# EasyEDA Pro project MyWordEdit.eprj, board PCB1 (continued)
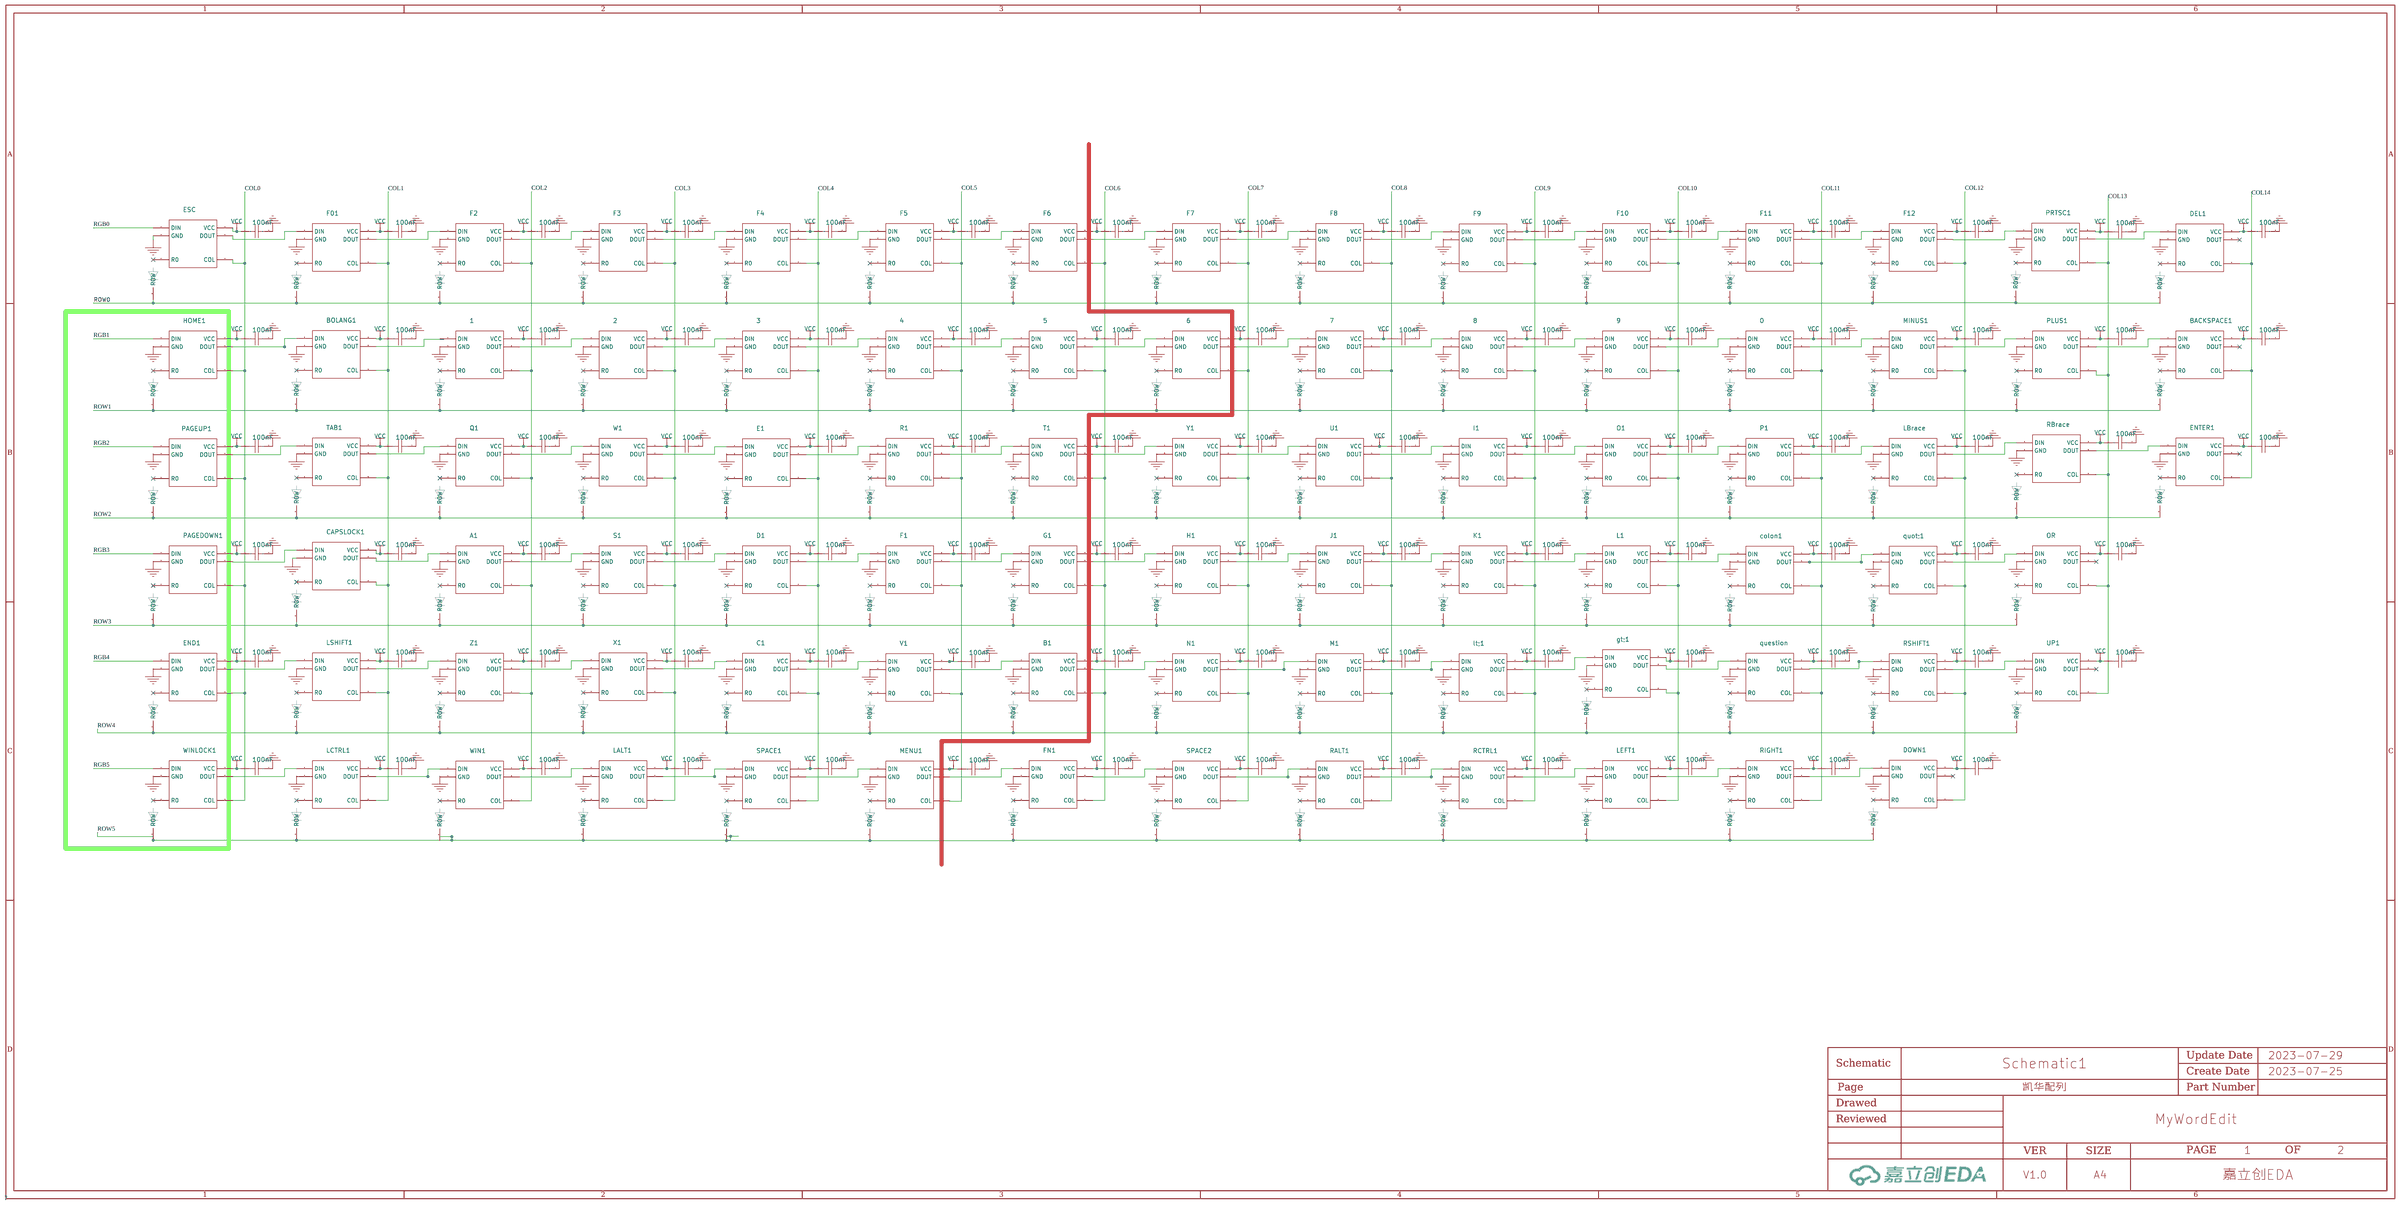
[diagram p0: 凯华配列]
## Routing (per net, layer and track width the routed paths; a pad name or vN(x,y) marks a point on that pad's centre or on a via; arc(x,y) is an arc through that point) (continued)
  Bottom Layer w0.254: v1(252.86,43.69) 252.86,45.17 253.03,45.34 252.9,45.47 ; 103.31,5.72 101.09,5.72 ; 103.31,5.72 107.19,5.72 108.08,4.83 POWER_BATTARY.2 ; 103.31,5.72 C3.2 ; 101.09,5.72 100.71,5.33 C4.2 ; 101.09,5.72 96.52,5.72 ; v1(172.09,110.49) 172.47,110.11 180.49,110.11 181.99,111.61 ; v1(192.66,92.58) 192.79,92.71 201.3,92.71 202.1,93.51 8.GND 202.63,94.74 v1(206.25,94.74) v1(206.25,96.39) ; v1(301.88,61.72) v1(304.29,59.31) ; v1(122.17,98.06) v1(122.17,94.11) 120.91,95.37 4.GND 117.03,95.12 116.28,94.36 109.73,94.36 109.47,94.61 108.46,94.61 v1(108.2,94.36) ; Z1.GND 81.28,41.4 v1(81.92,42.04) 77.39,46.56 57.2,46.56 v1(55.88,47.88) ; U1.GND 194.25,74.37 v1(197.87,74.37) 194.13,78.1 178.38,78.1 C_Y1.2 179.96,75.61 v1(179.96,74.17) ; v1(244.09,101.47) 243.18,102.39 C_00.2 ; v1(244.6,97.41) 244.6,98.97 243.8,99.78 ; v1(160.66,111.51) 157.04,111.51 F6.GND 156.66,110.87 155.77,109.98 148.08,109.98 v1(147.32,110.74) ; W1.GND 89.53,78.99 v1(90.3,79.76) 89.87,79.76 87.71,81.91 86.87,81.91 83.78,85 C_Q1.2 73.03,83.65 v1(73.03,82.8) ; 214.9,42.54 216.79,42.54 217.51,43.27 231.1,43.27 233.68,40.69 v1(233.68,40) 233.02,39.34 lt;1.GND ; 214.9,42.54 215.77,41.67 v1(215.77,40.39) ; 214.9,42.54 C_M1.2 ; v1(225.17,118.74) 223.57,120.35 C_F9.2 ; 143.26,114.17 v1(143.26,114.93) ; 143.26,114.17 141.86,112.77 137.74,112.77 137.74,112.52 136.98,111.76 129.16,111.76 v1(128.91,112.01) ; 143.26,114.17 v1(145.42,112.01) ; v1(105.92,120.14) 105.79,120.27 C_F3.2 ; v1(27.18,50.93) 27.18,44.14 25.08,42.04 v1(25.02,42.04) ; PAGEUP1.GND 21.54,94.36 24.64,94.36 26.92,96.65 26.92,101.47 ; 45.03,63.5 49.65,63.5 v1(50.67,64.52) 50.67,65.67 C_CAPSLOCK.2 48.83,67.5 47.88,66.55 46.1,66.55 45.34,67.31 36.45,67.31 v1(33.66,64.52) ; 36.32,8.51 35.01,7.2 C10.2 ; 36.32,8.51 32.35,8.51 ; 36.32,8.51 v1(38.1,8.51) 39.37,8.51 ; 26.92,101.47 v1(27.69,102.23) ; 26.92,101.47 25.03,99.58 C_PAGEUP.2 ; 295.57,64.11 295.53,64.07 295.53,63.37 294.64,62.48 283.34,62.48 v1(282.83,62.99) ; 295.57,64.11 298.59,67.13 C_OR.2 298.59,72.12 v1(297.31,73.41) ; 295.57,64.11 299.49,64.11 v1(299.85,63.75) ; v1(51.56,84.45) 54.1,86.99 61.85,86.99 64.26,84.58 68.2,84.58 v1(71.5,81.28) 70.99,80.77 68.14,80.77 Q1.GND ; v1(197.87,76.58) 197.87,78.98 C_U1.2 213.01,79.68 216.23,76.45 v1(216.15,76.45) 215.75,76.05 I1.GND ; ENTER1.GND 318.11,75.54 319.02,76.45 319.02,79.76 314.96,83.82 v1(295.78,83.82) ; v1(155.58,71.12) 155.58,70.97 157.61,68.94 SWD.4 ; 221.12,95.76 221.12,95.52 219.96,94.36 212.34,94.36 v1(212.22,94.23) ; 221.12,95.76 v1(225.3,95.76) 225.3,97.75 v1(225.43,97.88) ; 221.12,95.76 9.GND ; v1(284.73,100.96) 284.73,101.22 v1(282.83,103.12) 280.65,100.94 PLUS1.GND 277.91,100.5 276.73,99.31 v1(268.73,99.31) ; 51.94,48.63 51.94,45.08 50.92,44.06 LSHIFT1.GND ; 51.94,48.63 C_LSHIFT.2 ; 51.94,48.63 52.69,47.88 v1(54.23,47.88) ; v1(95.38,24.89) 119.89,24.89 C_SPACE1.2 123.32,21.46 v1(123.32,20.57) 121.66,18.92 SPACE1.GND ; 252.9,45.47 C_GT;1.2 ; 252.9,45.47 256.92,45.47 257.68,46.23 267.84,46.23 268.35,45.72 270,45.72 272.16,43.56 v1(272.16,42.67) 272.14,42.65 question.GND ; C_ENTER1.2 301.4,78.2 299.47,80.14 v1(296.04,80.14) 296.04,77.72 v1(297.31,76.45) ; 86.23,6.35 87.88,6.35 88.52,5.72 92.46,5.72 ; 86.23,6.35 85.22,5.34 C7.2 ; 86.23,6.35 77.85,6.35 76.45,7.75 71.62,7.75 ; v1(143.26,116.97) 141.47,116.97 C_F5.2 ; v1(31.88,101.6) 32.51,100.96 40.33,100.96 41.22,101.85 41.22,102.1 42.27,102.1 43.42,103.25 v1(46.36,103.25) 46.36,100.96 v1(46.86,100.46) ; 138.81,23.24 128.65,23.24 v1(125.98,20.57) ; 138.81,23.24 145.09,23.24 C_MENU1.2 150.05,21.15 152.78,18.42 152.78,17.4 v1(151.64,16.26) 151.51,16.12 MENU1.GND ; 138.81,23.24 134.24,27.81 134.24,30.73 135.13,31.62 135.13,32.26 137.16,34.29 v1(139.7,34.29) ; 113.67,127.38 113.92,127.38 114.43,126.87 114.43,125.44 RPROG.1 ; 113.67,127.38 114.54,128.25 C2.1 114.54,129.81 113.28,131.06 104.8,131.06 103.02,129.29 102.17,129.29 ; 113.67,127.38 110.09,127.38 C19.1 ; v1(101.73,42.16) 101.78,42.21 C_X1.2 103.81,42.42 116.08,42.42 117.09,41.4 117.86,41.4 v1(120.02,39.24) 118.87,38.1 116.91,38.1 ; v1(188.6,111.51) 186.69,113.41 v1(186.69,114.05) 184.25,111.61 181.99,111.61 ; v1(51.44,120.65) 50.29,121.79 43.63,121.79 ESC.GND 42.87,120.46 42.29,119.89 38.99,119.89 38.74,120.14 34.29,120.14 v1(33.53,120.9) ; C_H1.2 185.5,58.95 v1(186.54,57.91) 182.83,54.2 H1.GND ; RIGHT1.GND 305.79,26.64 v1(306.83,27.69) 305.05,29.46 303.78,29.46 302.77,30.48 288.39,30.48 C_LEFT1.2 288.09,29.59 v1(289.43,29.59) ; 222.77,62.26 v1(224.07,60.96) 220.62,57.51 219.62,57.51 ; 222.77,62.26 221.21,60.71 208.28,60.71 v1(205.36,57.78) 205.36,59.11 C_J1.2 ; 222.77,62.26 C_K1.2 ; 322.96,47.37 320.99,47.37 320.93,47.31 ; 322.96,47.37 v1(326.01,47.37) ; 322.96,47.37 323.99,48.4 C_UP1.2 323.99,55.36 321.69,57.66 v1(305.94,57.66) ; WINLOCK1.GND 16.71,37.59 19.3,37.59 20.2,38.49 C_WINLOCK.2 20.71,42.04 v1(23.24,42.04) ; C_PLUS1.2 282.16,105.69 v1(282.96,104.9) ; 19.75,75.18 21.97,75.18 v1(24.64,77.85) 24.64,78.63 C_PAGEDOWN.2 ; 32.35,8.51 C11.2 ; 32.35,8.51 27.78,8.51 C12.2 ; v1(149.61,76.58) 152.53,76.58 v1(154.43,74.68) ; v1(149.61,76.58) 149.61,76.59 144.92,81.28 142.88,81.28 142.55,81.61 142.55,93.17 v1(142.11,93.6) 143.89,93.6 v1(144.02,93.47) ; v1(149.61,76.58) 150.88,75.31 v1(150.88,70.87) ; v1(244.86,62.1) 246.76,64.01 259.17,64.01 C_COLON1.2 260.79,64.14 v1(262.06,62.86) 260,60.81 colon1.GND ; 138.55,36.44 138.94,36.44 v1(139.7,35.69) ; 138.55,36.44 138.55,37.85 v1(138.05,38.35) 136.91,39.5 136.65,39.5 135.31,40.84 122.53,40.84 C_C1.2 120.7,41.2 v1(120.65,41.15) ; 138.55,36.44 V1.GND ; v1(263.52,102.71) 263.52,103 C_MINUS1.2 ; v1(242.7,120.78) 241.5,121.98 C_F10.2 ; 243.8,99.78 241.53,97.51 0.GND 239.94,96.56 239.27,95.88 v1(230.63,95.88) ; 243.8,99.78 v1(243.84,99.82) ; v1(26.42,128.52) 26.42,128.4 27.43,127.38 30.04,127.38 32.13,125.29 32.13,122.05 v1(30.99,120.9) 29.34,120.9 C_ESC1.2 ; C_09.2 224.31,100.68 v1(225.43,99.57) ; C_B1.2 158.37,39.38 v1(158.37,40.51) ; C_F01.2 65.02,124.24 66.07,123.19 v1(67.95,123.19) 71.98,123.19 72.47,123.68 72.47,124.46 ; v1(229.36,114.55) 233.81,114.55 234.19,114.93 237.49,114.93 238.5,115.95 238.5,116.35 F10.GND 241.02,116.56 243.08,118.62 ; 323.09,27.7 323.36,27.43 v1(325.63,27.43) ; 323.09,27.7 v1(323.09,26.67) ; 323.09,27.7 DOWN1.GND 322.49,27.34 321.82,26.67 311.53,26.67 v1(309.37,28.83) 309.37,28.85 C_RIGHT1.2 ; v1(264.03,121.03) v1(264.03,118.24) 257.37,118.24 F11.GND 257.34,117.51 256.54,116.71 253.75,116.71 253.37,116.33 v1(248.41,116.33) ; U6.63 164.96,53.72 165.1,53.58 v1(165.1,53.34) ; O1.GND 233.74,79.25 v1(234.82,79.25) 233.68,80.39 232.41,80.39 231.14,81.66 217.59,81.66 216.79,80.86 C_I1.2 217.81,79.22 v1(217.81,78.23) ; C_01.2 64.52,105.28 v1(65.15,104.65) ; 249.72,41 252.32,41 v1(252.86,41.53) 249.94,44.45 233.95,44.45 C_LT;1.2 233.68,44.18 v1(233.68,42.54) ; v1(88.14,117.09) 86.74,118.49 v1(86.61,118.49) 85.85,117.72 F2.GND 80.84,117.15 80.28,116.59 72.52,116.59 v1(71.63,117.47) ; v1(87.76,119.63) 85.04,122.35 82.62,122.35 ; 96.52,5.72 92.46,5.72 ; 96.52,5.72 96.27,5.46 96.27,4.12 C5.2 ; 92.46,5.72 91.57,4.83 C6.2 ; v1(286,119.89) 294.27,119.89 295.31,120.93 295.31,121.51 295.42,121.41 v1(298.07,121.41) ; quot;1.GND 277.31,63.25 v1(280.04,63.25) 280.04,66.81 279.67,67.18 278.52,66.04 266.95,66.04 v1(263.78,62.86) ; R1.GND 127.25,75.56 v1(128.65,76.96) 127.74,77.88 127.23,77.88 124.2,80.9 110.45,80.9 110.11,81.24 ; C8.2 166.79,25.7 S2.2 170.28,26.95 169.16,28.07 C17.2 169.16,30.99 167.77,32.38 165.23,32.38 164.6,33.01 C18.2 163.79,33.02 v1(158.88,33.02) ; C_PRTSC1.2 300.61,124.53 v1(300.61,122.17) 301.12,121.67 313.18,121.67 ; 147.13,54.48 146.76,54.11 146.76,50.88 146.25,50.37 146.25,49.73 145.42,48.89 145.42,45.85 147.45,43.81 149.48,43.81 v1(153.8,39.5) ; 147.13,54.48 G1.GND ; 147.13,54.48 148.53,54.48 150.29,56.25 150.29,58.41 150.63,58.75 C_G1.2 150.5,59.57 v1(150.5,61.34) ; 109.03,57.91 111.38,57.91 v1(113.28,59.82) 113.28,61.66 C_D1.2 112.66,61.48 112.46,61.28 108.39,61.28 107.7,61.98 v1(97.03,61.98) ; C_05.2 140.28,98.22 v1(141.35,97.15) ; v1(53.21,64.52) 73.66,64.52 74.69,65.54 C_A1.2 75.31,65.16 v1(75.31,63.12) 73.4,61.21 A1.GND ; v1(27.18,53.97) v1(27.18,58.17) 27.31,58.17 v1(32.13,62.99) ; v1(53.09,29.72) 57.97,29.72 60.26,27.43 63.75,27.43 64.44,28.12 C_WIN1.2 65.91,28.58 v1(68.33,26.16) 66.04,23.88 60.65,23.88 60.65,23.87 ; v1(207.65,112.9) 207.65,113.79 v1(205.99,115.44) 203.81,113.26 F8.GND 200.66,112.92 200.66,112.65 199.77,111.76 197.08,111.76 196.83,111.51 v1(191.14,111.51) ; v1(162.94,53.34) 162.18,52.58 160.27,52.58 159.13,51.43 ; 110.11,81.24 v1(110.11,79.37) ; 110.11,81.24 C_E1.2 ; U6.47 158.42,52.14 159.13,51.43 ; v1(38.74,10.54) 46.07,10.54 51.53,5.08 C16.2 56.1,6.73 60.55,6.73 ; C_ESC1.2 C_HOME.2 14.99,121.79 8.01,114.81 5.23,114.81 SW_PWR_EN.1 4.32,115.86 ; C_ESC1.2 28.45,115.95 25.78,113.28 23.19,113.28 HOME1.GND ; BTK-05.22 BTK-05.23 154.84,123.47 153.42,122.05 153.42,117.42 BTK-05.13 148.46,117.35 146.43,119.38 135.38,119.38 133.73,117.73 131.06,117.73 129.67,119.13 v1(129.54,119.13) ; v1(153.8,39.5) 153.75,39.45 140.98,39.45 C_V1.2 139.19,40.96 v1(139.19,39.5) ; v1(153.8,39.5) 156.06,37.24 157.46,37.24 158.37,36.33 v1(158.37,35.05) 157.86,34.54 155,34.54 B1.GND ; v1(266.95,118.11) 267.21,118.36 275.84,118.36 276.26,118.78 F12.GND 276.29,119.89 v1(283.72,119.89) 283.72,121.28 v1(282.32,122.68) ; v1(159.89,93.48) 158.48,92.07 6.GND 155.01,91.49 154.57,91.06 146.81,91.06 v1(145.8,92.07) ; TAB1.GND 46.78,82.67 v1(48.65,84.54) 48.65,86.49 C_TAB.2 47,88.14 v1(33.15,88.14) ; 243.08,118.62 v1(243.08,119.25) ; 243.08,118.62 v1(245.24,116.46) ; v1(270.13,26.42) 270.13,26.62 C_RCTRL1.2 269.13,28.45 284.81,28.45 285.57,27.69 286,27.69 v1(287.91,25.78) 287.12,24.99 284.65,24.99 ; v1(69.34,118.87) v1(67.06,121.16) 65.27,119.38 62.1,119.38 60.96,118.24 57.91,118.24 57.66,118.49 53.47,118.49 v1(53.09,118.87) ; v1(286.39,100.96) 287.4,101.98 v1(292.48,101.98) 292.48,95.88 295.78,92.58 v1(295.78,83.82) ; C_BOLANG.2 45.97,106.81 v1(46.86,105.92) ; 183.05,92.56 184,92.56 v1(186.31,94.87) v1(186.31,92.58) ; C_Z1.2 82.93,45.69 ; 82.93,45.69 82.55,45.31 v1(82.55,44.2) ; 82.93,45.69 84.48,44.15 98.22,44.15 101.09,41.27 v1(101.09,40.51) 100.33,39.75 X1.GND ; 65.02,102.23 63.24,100.45 1.GND 60.14,99.87 59.71,99.44 51.44,99.44 v1(51.05,99.82) ; 65.02,102.23 v1(65.02,99.06) ; 65.02,102.23 v1(65.15,102.36) ; RALT1.GND 249.4,21.69 v1(249.94,22.22) 247.4,24.76 221.04,24.76 C_SPACE2.2 220.85,21.58 v1(220.85,20.83) ; v1(253.75,80.26) 252.03,80.26 251.12,79.35 ; C_08.2 205.41,99.14 v1(206.38,98.17) ; v1(114.94,59.82) 130.44,59.82 C_F1.2 131.7,60.84 v1(131.7,58.04) 129.92,56.26 F1.GND ; 181.99,111.61 F7.GND ; v1(178.82,73.02) 178.54,72.75 175.3,72.75 ; v1(89.03,96.77) 89.92,95.88 97.28,95.88 98.11,96.71 98.11,97.02 101.22,97.02 v1(103.51,99.31) 103.51,95.5 v1(103.38,95.38) ; v1(262.51,122.55) 261.75,123.32 260.36,123.32 ; 60.55,6.73 C15.2 ; 60.55,6.73 65.11,6.73 ; v1(327.91,29.72) 327.91,31.62 ; 327.91,31.62 v1(327.91,45.59) ; 327.91,31.62 326.52,33.02 325.64,33.02 ; 320.93,47.31 320.93,46.86 319.66,45.59 v1(302.01,45.59) ; 320.93,47.31 UP1.GND ; 163.32,45.72 164.96,44.08 U6.18 ; 163.32,45.72 162.69,46.35 v1(160.02,46.35) 158.62,46.35 157.96,47.02 157.96,50.27 159.13,51.43 ; 163.32,45.72 v1(164.97,45.72) ; 129.86,78.99 C_R1.2 ; 129.86,78.99 142.88,78.99 v1(147.57,74.29) 147.19,73.91 T1.GND ; 129.86,78.99 129.92,78.93 v1(129.92,77.98) ; 215.81,18.9 218.92,18.9 v1(219.58,19.56) 217.81,21.34 217.17,21.34 216.03,22.48 189.66,22.48 C_FN1.2 188.23,19.51 FN1.GND ; v1(77.34,63.12) 93.35,63.12 93.99,63.76 C_S1.2 95.25,62.87 v1(95.25,61.98) 92.83,59.56 S1.GND ; v1(109.35,113.92) 113.41,113.92 113.92,113.41 118.24,113.41 118.87,114.05 118.87,114.36 F4.GND 123.19,114.42 v1(124.97,116.2) 126.87,114.3 v1(126.87,114.17) ; E1.GND 107.92,77.31 v1(108.84,78.23) 108.84,78.76 105.81,81.79 103,81.79 101.35,83.44 C_W1.2 91.95,81.93 v1(91.95,80.39) ; 298.2,49.5 296.95,48.26 281.94,48.26 281.18,47.5 271.94,47.5 C_QUESTION.2 273.18,45.85 v1(273.18,45.59) ; 298.2,49.5 C_RSHIFT1.2 ; 298.2,49.5 298.2,46.61 v1(299.21,45.59) 298.55,44.93 RSHIFT1.GND ; 313.18,121.67 314.63,120.22 314.63,118.54 313.82,117.73 313.82,110.74 311.4,108.33 309.76,108.33 C_BACKSPACE.2 309.51,105.17 307.98,103.63 306.64,103.63 BACKSPACE1.GND 306.36,102.53 305.56,101.73 295.28,101.73 v1(295.02,101.98) ; 313.18,121.67 314.24,122.72 DEL1.GND 314.52,123.44 316.74,123.44 317.26,123.96 C_DEL1.2 ; C_LCTRL.2 46,27.48 v1(46.74,28.22) ; C_LCTRL.2 43.52,25.9 36.9,25.9 ; C_LCTRL.2 v1(45.1,25.65) ; C_06.2 158.51,96 159,95.5 v1(159.89,95.5) 162.43,98.04 v1(162.43,108.46) ; BOOT.5 BOOT.6 ; U3.2 74.17,3.05 73.91,2.79 72.26,2.79 70.92,4.14 70.92,7.04 71.62,7.75 ; v1(295.78,83.82) 295.91,83.69 v1(295.91,82.17) ; 82.62,122.35 79.58,122.35 78.99,122.94 78.99,124.46 USB1.B1 ; 82.62,122.35 C_F2.2 ; 39.37,8.51 39.84,8.04 C9.2 ; 39.37,8.51 42.8,8.51 43.31,8 43.31,5.08 44.2,4.19 46.33,4.19 46.61,4.47 U4.2 ; v1(140.72,95.5) 140.7,95.49 ; 140.7,95.49 v1(140.7,93.6) ; 140.7,95.49 138.93,93.72 5.GND 136.02,93.65 136.02,93.09 135.51,92.58 127,92.58 v1(125.73,93.85) ; v1(162.43,111.51) 163.74,112.81 C_F6.2 167.13,113.41 v1(169.55,111) ; v1(248.03,83.31) 235.41,83.31 234.99,82.89 ; U6.12 167.38,47.12 v1(166.24,47.12) ; C_F8.2 204.59,118.5 v1(205.87,117.22) ; C_03.2 102.4,101.85 v1(103.76,101.85) ; 65.11,6.73 C14.2 ; 65.11,6.73 68.58,6.73 ; C_02.2 84.28,103.43 v1(84.46,103.25) ; LALT1.GND 89.66,21.71 v1(92.84,24.89) 91.44,26.29 C_LALT1.2 88.02,25.41 87.12,24.51 84.46,24.51 82.8,26.16 v1(71.76,26.16) ; 68.58,6.73 67.91,6.06 C13.2 ; 68.58,6.73 69.6,7.75 71.62,7.75 ; v1(69.72,99.06) 71.12,97.66 78.49,97.66 79.19,98.37 2.GND 82.3,98.67 v1(84.33,96.65) v1(84.33,100.08) ; v1(186.69,115.95) 185.72,116.92 C_F7.2 ; v1(197.36,38.35) 197.36,39.86 196.15,41.07 ; v1(107.32,115.82) v1(105.03,118.11) 102.99,116.07 F3.GND 100.08,115.76 100.08,115.44 99.57,114.93 97.03,114.93 96.77,115.19 v1(91.19,115.19) ; L1.GND 239.98,59.16 v1(242.92,62.1) 242.92,62.65 C_L1.2 241.69,63.13 240.79,62.23 227.33,62.23 v1(226.06,60.96) ; v1(27.05,77.85) 27.05,82.04 v1(31.62,86.61) ; v1(249.68,97.41) 249.81,97.54 258.45,97.54 258.99,98.08 258.99,99.16 261.55,99.16 v1(263.52,101.13) 263.53,101.12 v1(263.53,99.57) ; 279.21,125.15 281.5,125.15 v1(282.07,124.59) ; v1(276.48,81.41) 277.11,81.41 281.43,85.72 289.48,85.72 C_RBRACE.2 292.84,85.49 v1(292.84,83.69) 291.92,82.78 RBrace.GND ; J1.GND 203.43,55.85 v1(203.96,56.39) 201.55,58.8 189.23,58.8 v1(188.34,57.91) ; v1(50.29,29.72) v1(48.13,29.72) ; 234.99,82.89 C_O1.2 ; 234.99,82.89 234.99,81.87 v1(236.73,80.14) ; C_F4.2 v1(124.33,119.13) v1(126.37,119.13) ; 96.72,126.75 97.66,126.75 97.79,126.62 97.79,125.6 98.17,125.22 100.71,125.22 101.09,125.6 101.09,126.52 101.31,126.75 102.17,126.75 102.19,126.77 108.44,126.77 108.69,126.52 109.58,126.52 111.63,124.46 113.45,124.46 RPROG.1 ; v1(187.71,97.28) 187.58,97.41 C_07.2 ; v1(209.88,94.74) v1(207.82,94.74) ; RPROG.1 v1(116.33,125.35) ; END1.GND 23.11,56.26 v1(25.02,58.17) 25.02,58.3 C_END.2 ; 211.75,37.69 215.24,37.69 v1(215.77,38.23) 213.49,40.51 212.6,40.51 211.58,41.53 196.61,41.53 196.15,41.07 ; 196.15,41.07 C_N1.2 ; v1(249.94,24.76) 249.94,26.22 C_RALT1.2 250.19,26.8 265.81,26.8 v1(268.48,24.13) 267.69,23.34 RCTRL1.GND ; v1(226.82,114.81) 226.82,115.6 v1(225.17,117.25) 222.83,114.91 219.37,114.91 219.37,114.08 218.57,113.28 210.57,113.28 v1(210.31,113.03) ; v1(149.48,65.02) 149.35,65.02 144.12,59.79 140.31,59.79 138.43,57.91 133.86,57.91 v1(133.73,58.04) ; v1(122.17,100.05) 122.15,100.08 C_04.2 ; v1(265.81,99.57) 266.57,99.57 v1(267.46,100.46) ; N1.GND 193.1,36.32 195.33,36.32 v1(196.22,37.21) ; LBrace.GND 270.45,81.41 v1(274.25,81.41) 274.25,85.12 C_LBRACE.2 271.33,84.33 263.27,84.33 259.21,80.26 v1(256.16,80.26) 256.16,82.31 C_P1.2 253.12,83.31 v1(250.06,83.31) ; v1(190.77,92.58) v1(189.23,92.58) ; v1(158.5,41.91) 158.5,43.16 U6.31 158.5,43.23 158.5,44.2 158.75,44.45 v1(158.75,44.58)
VBUS1: length 13.9
  Top Layer w0.254: v1(84.71,129.29) 84.58,129.29 82.42,127.13 79.23,127.13 78.06,125.96 78.06,123.49 v1(78.36,123.19)
  Bottom Layer w0.254: v1(78.36,123.19) 78.13,123.42 USB1.B4 ; v1(84.71,129.29) F15.2
VBUS2: length 29.5
  Top Layer w0.254: v1(75.57,127) 75.69,126.87 v1(75.69,123.32) ; v1(76.07,130.56) v1(73.91,130.56) ; v1(90.42,130.56) v1(87.12,130.56)
  Bottom Layer w0.254: v1(90.42,130.56) 91.08,129.9 F17.2 ; v1(75.69,123.32) 73.58,123.32 73.33,123.57 USB1.A4 ; v1(75.57,127) 75.57,128.9 v1(73.91,130.56) ; v1(76.07,130.56) v1(87.12,130.56)
VCC: length 2729.4
  Top Layer w0.254: v1(278.13,49.02) 279.15,48.01 v1(279.15,46.48) ; v1(241.55,25.65) 241.81,25.65 v1(243.08,26.92) ; v1(40.39,87.5) 42.04,89.15 v1(42.16,89.15) ; v1(108.08,101.98) v1(106.3,103.76) ; v1(190.12,93.73) v1(190.12,97.54) v1(188.47,99.19) ; v1(190.12,93.73) v1(190.12,91.49) ; v1(190.12,93.73) v1(192.79,93.73) ; v1(149.35,113.41) 149.35,115.06 v1(148.84,115.57) ; v1(96.9,82.68) 96.9,82.73 v1(95.25,84.38) ; v1(188.21,18.16) v1(187.07,19.3) ; v1(90.42,98.42) 90.3,98.42 v1(89.03,99.69) ; v1(129.41,97.03) 128.4,98.04 v1(128.4,98.81) ; v1(28.32,81.28) v1(24.81,81.28) ; v1(70.23,27.69) 70.74,27.18 v1(73.53,27.18) v1(73.53,25.15) ; v1(178.82,96.65) 178.69,96.65 v1(176.91,94.87) ; v1(136.65,22.48) 135.89,23.24 v1(135.89,24.38) ; v1(208.41,23.88) 207.39,22.86 v1(207.39,21.59) ; v1(51.82,89.15) v1(48.01,89.15) ; v1(262.38,82.17) v1(259.59,82.17) ; v1(227.84,101.85) 229.74,101.85 v1(229.87,101.73) ; v1(248.54,104.01) v1(246.13,104.01) ; v1(238.25,84.07) 238.25,82.55 v1(238.76,82.04) ; v1(268.61,65.02) v1(268.61,67.18) ; v1(97.54,26.54) 97.16,26.92 v1(95,26.92) ; v1(34.16,84.58) v1(32.51,84.58) ; v1(52.45,68.45) v1(50.7,68.45) ; v1(170.56,112.78) v1(173.23,112.78) ; v1(51.31,102.74) 52.07,101.98 v1(53.09,101.98) ; v1(316.74,31.11) 316.74,32.38 v1(317.37,33.02) ; v1(68.71,122.43) 68.71,123.82 v1(69.22,124.33) ; v1(66.42,88.14) v1(63.88,88.14) ; v1(297.82,29.84) 297.82,30.86 v1(299.47,32.51) ; v1(78.61,84.2) 77.62,84.2 v1(76.03,85.78) ; v1(249.17,121.67) 249.17,120.4 v1(250.06,119.51) ; v1(231.39,83.44) v1(228.85,83.44) ; v1(128.27,40.26) 127.89,40.26 v1(126.62,41.53) ; v1(188.47,53.34) v1(188.47,51.18) ; v1(192.66,57.91) 192.66,59.31 v1(193.55,60.2) ; v1(246.63,47.5) v1(249.05,47.5) ; v1(74.55,67.56) 77.09,67.56 v1(77.22,67.44) ; v1(55.88,46.61) v1(51.18,46.61) ; v1(53.47,122.81) 53.47,122.68 v1(54.74,121.41) ; v1(181.99,72.26) 181.36,71.63 v1(181.36,70.1) ; v1(131.57,62.61) 133.48,62.61 v1(134.11,61.98) ; v1(115.06,63.88) 114.43,64.52 v1(112.52,64.52) ; v1(256.67,29.08) 255.27,27.69 v1(254.64,27.69) ; v1(58.42,28.07) 59.69,28.07 v1(60.07,28.45) ; v1(133.22,41.53) 136.02,41.53 v1(136.14,41.66) ; v1(302.13,50.04) v1(299.94,50.04) ; v1(210.95,118.36) 211.84,117.47 v1(211.84,116.08) ; v1(270.64,101.09) 269.88,101.85 v1(269.88,102.87) ; v1(96.14,45.08) v1(98.68,45.08) ; v1(219.84,80.64) 218.82,81.66 v1(218.82,82.42) ; v1(230.76,61.34) 230.76,61.36 228.88,63.25 v1(228.85,63.25) ; v1(20.19,122.55) 20.19,122.43 v1(18.67,120.9) ; v1(289.81,124.08) 289.31,124.08 v1(288.04,125.35) ; v1(114.68,43.31) v1(117.35,43.31) ; v1(111.38,119) 111.38,117.35 v1(111.76,116.97) ; v1(256.03,46.23) 256.03,44.83 v1(256.67,44.2) ; v1(130.68,114.17) 130.68,116.59 v1(129.92,117.35) ; v1(141.1,41.27) 143.26,41.27 v1(145.67,38.86) ; v1(209.3,42.67) 210.57,43.94 v1(211.71,43.94) ; v1(264.03,67.18) v1(261.93,67.18) ; v1(266.45,105.79) 266.57,105.66 v1(268.73,105.66) ; v1(70.99,103.25) 70.99,101.85 v1(71.5,101.35) ; v1(210.82,100.71) v1(208.28,100.71) ; v1(125.6,25.02) 123.57,25.02 v1(122.81,25.78) ; v1(192.79,114.17) 192.15,114.81 v1(192.15,116.08) ; v1(72.14,121.16) 73.41,119.89 v1(73.66,119.89) ; v1(246.63,84.71) 248.52,84.71 v1(248.6,84.79) ; v1(138.94,56.9) v1(136.78,56.9) ; v1(54.48,88.14) 54.99,87.63 v1(54.99,85.85) ; 109.98,99.95 v1(109.98,98.04) ; v1(201.04,80.64) 201.04,79.12 v1(201.93,78.23) ; v1(193.04,81.41) 192.41,80.77 v1(192.41,79.63) ; v1(200.41,61.98) 198.63,60.2 v1(197.87,60.2) ; v1(109.73,43.31) 109.73,43.18 v1(111.25,41.66) ; v1(161.04,19.18) v1(157.86,19.18) ; v1(135.38,57.06) v1(135.38,58.55) ; v1(79.5,62.36) v1(79.5,65.02) ; v1(188.34,60.2) v1(184.4,60.2) ; v1(50.8,124.33) 49.91,123.44 v1(48.77,123.44) ; v1(92.46,120.2) 92.46,118.74 v1(92.71,118.49) ; v1(275.97,87.76) v1(273.42,87.76) ; v1(244.48,65.28) v1(242.94,65.28) ; v1(105.03,84.33) v1(102.87,84.33) ; v1(270,122.55) 268.73,122.55 v1(267.21,124.08) ; v1(232.54,98.93) v1(231.14,100.33) ; v1(143,80.26) v1(141.01,80.26) ; v1(117.35,58.93) v1(117.35,61.59) ; v1(113.28,25.78) v1(115.57,23.5) ; v1(204.72,40.51) 204.72,41.53 v1(203.58,42.67) ; v1(297.31,70.99) 297.82,71.5 v1(301.75,71.5) ; v1(51.31,108.46) 51.44,108.46 v1(52.96,106.93) ; v1(250.19,102.49) 250.19,101.22 v1(251.33,100.08) ; v1(132.46,80.26) v1(132.46,78) ; v1(87,121.67) v1(84.56,121.67) ; v1(89.03,45.08) 90.55,43.56 v1(91.31,43.56) ; v1(223.77,25.65) 225.55,23.88 v1(225.55,23.75) ; v1(181.23,78.87) 181.99,78.1 v1(181.99,77.09) ; v1(145.16,98.55) 144.02,99.69 v1(143.51,99.69) ; v1(188.98,39.62) 190.25,39.62 v1(191.26,40.64) ; v1(98.55,62.86) 98.55,61.09 v1(98.93,60.71) ; v1(282.83,69.09) v1(279.91,69.09) ; v1(154.31,41.27) 153.04,41.27 v1(152.02,40.26) ; v1(34.42,66.29) v1(36.32,66.29) ; v1(182.63,65.53) 181.86,64.77 v1(181.86,64.52) ; v1(253.37,25.91) 252.35,26.92 v1(252.35,27.69) ; v1(95.5,65.91) 96.77,65.91 v1(97.28,65.4) ; v1(304.18,75.31) v1(306.32,75.31) ; v1(224.16,63.5) 225.81,63.5 v1(226.06,63.25) ; v1(36.45,107.44) v1(39.37,107.44) ; v1(218.82,42.29) v1(217.17,43.94) ; v1(278.77,30.23) 278.77,28.19 v1(278.13,27.56) ; v1(208.41,58.93) 208.41,59.05 v1(206.88,60.58) ; v1(227.97,45.72) v1(230.12,45.72) ; v1(247.02,62.74) v1(245.62,64.13) ; v1(66.68,106.3) v1(68.2,104.77) ; v1(237.87,43.43) v1(236.09,45.21) ; 29.21,103.76 31.88,103.76 v1(32,103.63) ; 29.21,103.76 v1(27.81,103.76) ; 29.21,103.76 v1(30.1,104.65) ; v1(30.23,64.9) v1(31.62,66.29) ; v1(58.42,66.17) 58.42,64.9 v1(59.56,63.75) ; v1(77.09,45.97) 78.61,45.97 v1(79.38,46.74) ; v1(285.24,107.44) 288.04,107.44 v1(288.29,107.19) ; v1(48.39,28.19) v1(50.04,26.54) ; v1(26.67,62.61) v1(24.51,62.61) ; v1(126.11,82.55) v1(124.21,82.55) ; v1(209.8,82.17) v1(211.07,83.44) ; v1(232.03,118.74) 231.14,118.74 v1(229.87,120.01) ; v1(169.04,77.22) v1(169.04,75.44) ; v1(87.12,104.9) v1(88.9,103.12) ; v1(26.54,28.32) v1(25.02,28.32) ; v1(124.97,102.23) v1(126.87,100.33) ; v1(34.54,46.23) v1(33.27,44.96) ; v1(279.65,82.68) v1(277.5,84.84) ; v1(33.53,9.78) v1(33.53,7.75) ; v1(212.22,97.15) v1(213.49,95.88) ; v1(112.78,82.55) 112.78,81.15 v1(113.92,80.01) ; v1(263.91,49.02) v1(267.72,49.02) ; v1(85.98,85.85) v1(82.8,85.85) ; v1(148.59,95.12) v1(147.07,96.65) ; v1(151.13,19.18) v1(153.8,19.18) ; v1(30.86,123.32) v1(35.31,123.32)